# EasyEDA Pro project ProProject_IMUSensorNodes202312.epro, board 6_6_拼板20240123（不带编号） (continued)
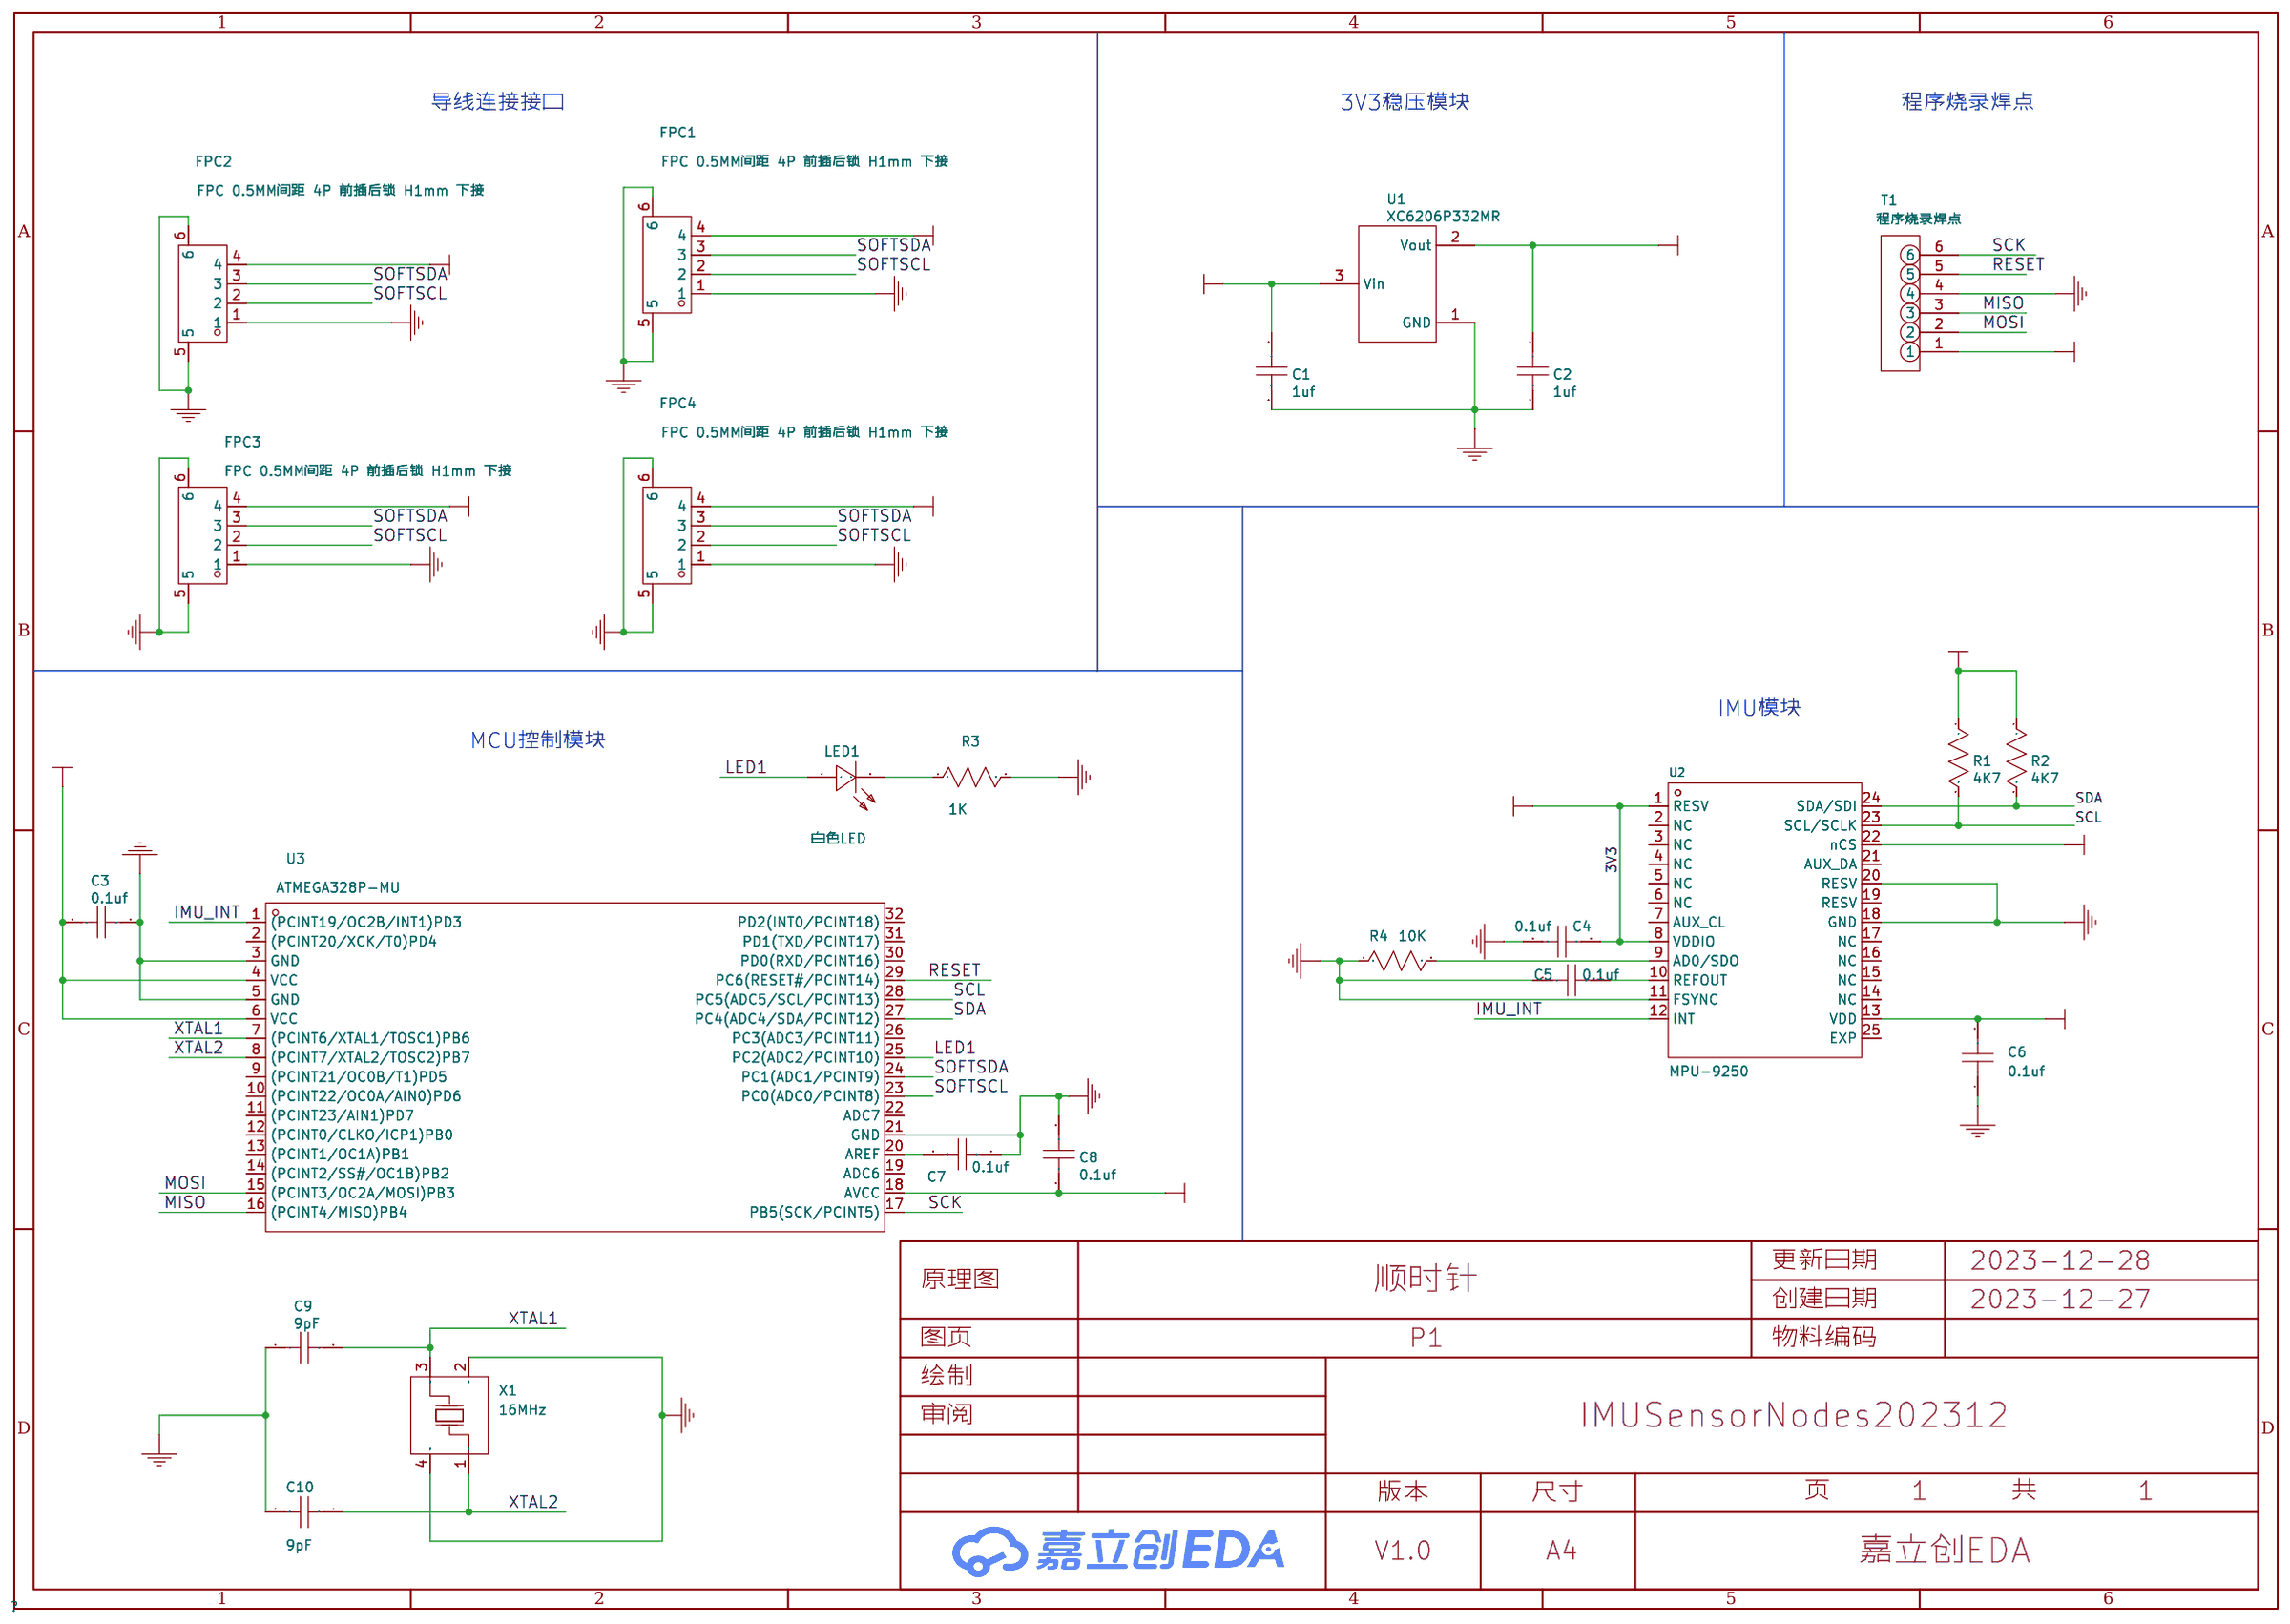
[diagram p0: schematic sheet]
## Routing (per net, layer and track width the routed paths; a pad name or vN(x,y) marks a point on that pad's centre or on a via; arc(x,y) is an arc through that point) (continued)
  Bottom Layer w0.2: U3#90.33 17.81,3.72 v1(17.81,2.38) U3#90.21 ; 17.32,21.72 17.32,22.02 18.32,23.02 U2#22.25 18.92,22.54 U2#22.11 20.54,22.54 v1(20.73,22.35) 21.27,22.88 C5#10.1 R4#9.1 ; U3#69.21 v1(45.12,70.96) 45.12,72.3 U3#69.33 ; R4#8.1 C5#9.1 7.68,22.76 7.43,22.51 6.07,22.51 U2#33.11 ; U3#86.21 v1(45.12,2.38) 45.12,3.72 U3#86.33 ; R4#7.1 C5#8.1 75.88,77.74 v1(75.34,77.21) 75.15,77.41 73.53,77.41 U2#36.25 72.93,77.88 71.93,76.88 U2#36.18 ; R4#19.1 C5#20.1 7.68,77.62 7.43,77.37 6.07,77.37 6.03,77.41 ; U2#2.18 44.62,22.02 45.62,23.02 U2#2.25 46.22,22.54 U2#2.11 47.84,22.54 v1(48.04,22.35) 48.57,22.88 C5#12.1 R4#11.1 ; U3#71.33 17.81,72.3 v1(17.81,70.96) U3#71.21 ; R4#26.1 C5#27.1 34.98,63.91 34.73,63.66 33.37,63.66 U2#31.11 ; R4.1 C5.1 75.88,22.88 v1(75.34,22.35) 75.15,22.54 U2#35.11 73.53,22.54 U2#35.25 72.93,23.02 71.93,22.02 U2#35.18 ; R4#29.1 C5#30.1 75.88,64.03 v1(75.34,63.5) 75.15,63.69 U2#32.11 73.53,63.69 U2#32.25 72.93,64.16 71.93,63.16 U2#32.18 ; R4#13.1 C5#14.1 7.68,9.04 7.43,8.79 6.07,8.79 U2#11.11 ; U3#61.21 v1(72.42,57.25) 72.42,58.58 U3#61.33 ; U3#84.33 17.81,44.86 v1(17.81,43.53) U3#84.21 ; 33.34,77.41 33.37,77.37 34.73,77.37 34.98,77.62 C5#23.1 R4#22.1 ; R4#34.1 C5#35.1 62.29,50.19 62.04,49.94 60.68,49.94 60.64,49.97 ; R4#4.1 C5#5.1 48.57,36.59 v1(48.04,36.06) 47.84,36.26 U2#3.11 46.22,36.26 U2#3.25 45.62,36.73 44.62,35.73 U2#3.18 ; U2#10.11 60.68,36.22 62.04,36.22 62.29,36.47 C5#6.1 R4#5.1 ; U3#64.33 45.12,44.86 v1(45.12,43.53) U3#64.21 ; U2#29.11 6.07,63.66 7.43,63.66 7.68,63.91 C5#25.1 R4#24.1 ; R4#20.1 C5#22.1 62.29,77.62 62.04,77.37 60.68,77.37 60.64,77.41 ; U3#78.21 v1(45.12,57.25) 45.12,58.58 U3#78.33 ; U3#87.33 72.42,31.15 v1(72.42,29.81) U3#87.21 ; 17.32,76.58 17.32,76.88 18.32,77.88 U2#7.25 18.92,77.41 20.54,77.41 v1(20.73,77.21) 21.27,77.74 C5#21.1 R4#21.1 ; U2#6.18 71.93,49.45 72.93,50.45 U2#6.25 73.53,49.97 75.15,49.97 v1(75.34,49.78) 75.88,50.31 C5#36.1 R4#35.1 ; U3#81.33 17.81,31.15 v1(17.81,29.81) U3#81.21 ; U3#83.21 v1(72.42,70.96) 72.42,72.3 U3#83.33 ; U2#8.11 33.37,36.22 34.73,36.22 34.98,36.47 C5#4.1 R4#3.1 ; U3#62.33 45.12,17.43 v1(45.12,16.1) U3#62.21 ; R4#16.1 C5#17.1 48.57,9.16 v1(48.04,8.63) 47.84,8.83 U2#19.11 46.22,8.83 U2#19.25 45.62,9.3 44.62,8.3 U2#19.18 ; U2#5.18 44.62,49.45 45.62,50.45 U2#5.25 46.22,49.97 47.84,49.97 v1(48.04,49.78) 48.57,50.31 C5#34.1 R4#33.1 ; R4#10.1 C5#11.1 34.98,22.76 34.73,22.51 33.37,22.51 U2#9.11 ; 33.34,49.97 33.37,49.94 34.73,49.94 34.98,50.19 C5#33.1 R4#32.1 ; U3#95.33 17.81,17.43 v1(17.81,16.1) U3#95.21 ; U2#4.11 6.07,36.22 7.43,36.22 7.68,36.47 C5#2.1 R4#36.1 ; U3#80.33 72.42,3.72 v1(72.42,2.38) U3#80.21 ; R4#15.1 C5#16.1 34.98,9.04 34.73,8.79 33.37,8.79 U2#25.11 ; R4#14.1 C5#15.1 21.27,9.16 v1(20.73,8.63) 20.54,8.83 U2#18.11 18.92,8.83 U2#18.25 18.32,9.3 17.32,8.3 17.32,8 ; R4#23.1 C5#24.1 48.57,77.74 v1(48.04,77.21) 47.84,77.41 46.22,77.41 U2#24.25 45.62,77.88 44.62,76.88 U2#24.18 ; U3#94.21 v1(72.42,16.1) 72.42,17.43 U3#94.33 ; U2#13.11 60.68,63.66 62.04,63.66 62.29,63.91 C5#29.1 R4#28.1 ; U3#67.21 v1(72.42,43.53) 72.42,44.86 U3#67.33 ; U2#23.11 60.68,8.79 62.04,8.79 62.29,9.04 C5#18.1 R4#17.1 ; R4#31.1 C5#32.1 21.27,50.31 v1(20.73,49.78) 20.54,49.97 18.92,49.97 U2#14.25 18.32,50.45 17.32,49.45 17.32,49.15 ; R4#27.1 C5#28.1 48.57,64.03 v1(48.04,63.5) 47.84,63.69 U2#34.11 46.22,63.69 U2#34.25 45.62,64.16 44.62,63.16 U2#34.18 ; 17.32,35.43 17.32,35.73 18.32,36.73 U2#28.25 18.92,36.26 U2#28.11 20.54,36.26 v1(20.73,36.06) 21.27,36.59 C5#3.1 R4#2.1 ; 6.03,49.97 6.07,49.94 7.43,49.94 7.68,50.19 C5#31.1 R4#30.1 ; R4#18.1 C5#19.1 75.88,9.16 v1(75.34,8.63) 75.15,8.83 U2#20.11 73.53,8.83 U2#20.25 72.93,9.3 71.93,8.3 U2#20.18 ; U3#88.21 v1(17.81,57.25) 17.81,58.58 U3#88.33 ; R4#12.1 C5#13.1 62.29,22.76 62.04,22.51 60.68,22.51 U2#17.11 ; U2#16.18 71.93,35.73 72.93,36.73 U2#16.25 73.53,36.26 U2#16.11 75.15,36.26 v1(75.34,36.06) 75.88,36.59 C5#7.1 R4#6.1 ; U3#79.21 v1(45.12,29.81) 45.12,31.15 U3#79.33 ; 17.32,62.86 17.32,63.16 18.32,64.16 U2#12.25 18.92,63.69 U2#12.11 20.54,63.69 v1(20.73,63.5) 21.27,64.03 C5#26.1 R4#25.1
  Bottom Layer w0.254: 36.88,38.13 37.12,38.13 37.27,37.98 v2(37.27,37.88) 37.27,36.98 37.14,36.86 ; v1(0.92,28.98) 0.54,29.37 0.54,29.87 0.92,30.25 3.21,30.25 U3#65.33 ; U3#79.5 45.62,31.65 U3#79.33 45.24,31.4 v1(44.73,31.91) 44.62,32.02 U3#79.3 ; v1(42.6,21.71) 42.71,21.71 42.93,21.49 42.93,20.98 ; U3#80.3 71.92,4.59 v1(72.04,4.47) 72.55,3.97 U3#80.33 72.92,4.22 U3#80.5 ; C10#24.2 50.98,78.13 v1(50.98,79) 50.7,79.28 C9#24.1 ; C7#35.1 72.42,41.97 U3#67.21 ; C1#10.2 48.52,19.23 49,18.75 v1(49.28,18.75) 48.52,17.98 C8#10.2 ; U3#69.5 45.62,72.8 U3#69.33 45.24,72.55 v1(44.73,73.05) 44.62,73.17 U3#69.3 ; C8#8.2 21.21,17.98 v1(21.98,18.75) 21.7,18.75 21.21,19.23 C1#8.2 ; U3#85.33 57.82,2.82 55.53,2.82 55.15,2.44 55.15,1.93 v1(55.53,1.55) ; C8.2 21.21,31.7 v1(21.98,32.46) 21.7,32.46 21.21,32.95 C1.2 ; C1#33.2 48.52,46.66 49,46.18 v1(49.28,46.18) 48.52,45.41 C8#33.2 ; U2#22.20 17.72,22.54 arc(17.79,22.55) 17.86,22.56 arc(18.14,22.72) 18.3,23 arc(18.31,23.07) U2#22.25 ; C8#12.2 75.82,17.98 v1(76.59,18.75) 76.31,18.75 75.82,19.23 C1#12.2 ; U3#78.3 44.62,59.45 v1(44.73,59.34) 45.24,58.83 U3#78.33 45.62,59.08 U3#78.5 ; v1(69.9,35.43) 70.01,35.43 70.24,35.21 70.24,34.7 ; U3#73.33 30.51,16.54 28.22,16.54 27.84,16.16 27.84,15.65 v1(28.22,15.27) ; C9#22.1 23.39,79.28 v1(23.67,79) 23.67,78.13 C10#22.2 ; C9#30.1 78,65.56 v1(78.28,65.28) 78.28,64.41 C10#30.2 ; C7#31.1 17.81,41.97 U3#84.21 ; C9#2.1 78,24.41 v1(78.28,24.13) 78.28,23.26 C10#2.2 ; U3#87.21 72.42,28.25 C7#5.1 ; U3#94.5 72.92,17.93 U3#94.33 72.55,17.68 v1(72.04,18.19) 71.92,18.31 U3#94.3 ; C7#25.1 17.81,55.68 U3#88.21 ; v1(42.6,35.43) 42.71,35.43 42.93,35.21 42.93,34.7 ; v1(52.35,60.35) C2#27.2 ; U3#62.21 45.12,14.54 C7#10.1 ; C9#28.1 50.7,65.56 v1(50.98,65.28) 50.98,64.41 C10#28.2 ; C1#3.2 48.52,32.95 49,32.46 v1(49.28,32.46) 48.52,31.7 C8#3.2 ; C7#29.1 72.42,55.68 U3#61.21 ; C8#16.2 48.52,4.27 v1(49.28,5.03) 49,5.03 48.52,5.52 C1#16.2 ; v1(28.22,42.7) 27.84,43.08 27.84,43.59 28.22,43.97 30.51,43.97 U3#75.33 ; 9.58,38.13 9.81,38.13 9.96,37.98 v2(9.96,37.88) 9.96,36.98 9.84,36.86 ; v1(56.42,49.81) 56.42,49.41 C3#34.2 ; v1(29.11,49.81) 29.11,49.41 C3#32.2 ; v1(69.9,21.71) 70.01,21.71 70.24,21.49 70.24,20.98 ; U2#3.20 45.02,36.26 arc(45.1,36.26) 45.17,36.28 arc(45.45,36.44) 45.61,36.71 arc(45.62,36.79) U2#3.25 ; v1(79.66,74.07) C2#6.2 ; C1#23.2 48.52,74.1 49,73.61 v1(49.28,73.61) 48.52,72.85 C8#23.2 ; C3#7.2 1.81,21.97 v1(1.81,22.38) ; v1(79.66,19.21) C2#12.2 ; v1(79.66,32.92) C2#5.2 ; v1(1.81,77.25) 1.81,76.84 C3#19.2 ; v1(0.92,15.27) 0.54,15.65 0.54,16.16 0.92,16.54 3.21,16.54 U3#72.33 ; U3#64.3 44.62,45.74 v1(44.73,45.62) 45.24,45.11 U3#64.33 45.62,45.36 U3#64.5 ; U3#86.21 45.12,0.82 C7#16.1 ; U3#79.21 45.12,28.25 C7#3.1 ; 9.58,24.41 9.81,24.41 9.96,24.26 v2(9.96,24.16) 9.96,23.27 9.84,23.14 ; 36.88,65.56 37.12,65.56 37.27,65.41 v2(37.27,65.31) 37.27,64.42 37.14,64.29 ; C10#32.2 23.67,50.7 v1(23.67,51.57) 23.39,51.84 C9#32.1 ; 37.14,23.14 37.27,23.27 v2(37.27,24.16) 37.27,24.26 37.12,24.41 36.88,24.41 ; 37.14,78.01 37.27,78.13 v2(37.27,79.02) 37.27,79.13 37.12,79.28 36.88,79.28 ; v1(25.05,60.35) C2#25.2 ; C1#21.2 21.21,74.1 21.7,73.61 v1(21.98,73.61) 21.21,72.85 C8#21.2 ; C7#27.1 45.12,55.68 U3#78.21 ; U3#83.3 71.92,73.17 v1(72.04,73.05) 72.55,72.55 U3#83.33 72.92,72.8 U3#83.5 ; C10#9.2 78.28,78.13 v1(78.28,79) 78,79.28 C9#9.1 ; C3#28.2 56.42,63.12 v1(56.42,63.53) ; v1(69.9,8) 70.01,8 70.24,7.78 70.24,7.27 ; C7#12.1 72.42,14.54 U3#94.21 ; v1(29.11,77.25) 29.11,76.84 C3#22.2 ; 64.45,50.58 64.57,50.7 v2(64.57,51.59) 64.57,51.69 64.42,51.84 64.19,51.84 ; C3#2.2 29.11,35.69 v1(29.11,36.1) ; C1#31.2 21.21,46.66 21.7,46.18 v1(21.98,46.18) 21.21,45.41 C8#31.2 ; 64.19,65.56 64.42,65.56 64.57,65.41 v2(64.57,65.31) 64.57,64.42 64.45,64.29 ; 9.58,79.28 9.81,79.28 9.96,79.13 v2(9.96,79.02) 9.96,78.13 9.84,78.01 ; v1(52.35,46.64) C2#33.2 ; C3#9.2 29.11,21.97 v1(29.11,22.38) ; C3#11.2 56.42,21.97 v1(56.42,22.38) ; 42.93,48.42 42.93,48.92 42.71,49.15 v1(42.6,49.15) ; v1(52.35,74.07) C2#23.2 ; C8#18.2 75.82,4.27 v1(76.59,5.03) 76.31,5.03 75.82,5.52 C1#18.2 ; U3#88.5 18.31,59.08 U3#88.33 17.94,58.83 v1(17.43,59.34) 17.31,59.45 U3#88.3 ; 64.45,78.01 64.57,78.13 v2(64.57,79.02) 64.57,79.13 64.42,79.28 64.19,79.28 ; C1#29.2 75.82,60.38 76.31,59.89 v1(76.59,59.89) 75.82,59.13 C8#29.2 ; C8#27.2 48.52,59.13 v1(49.28,59.89) 49,59.89 48.52,60.38 C1#27.2 ; v1(79.66,46.64) C2#35.2 ; U2#2.20 45.02,22.54 arc(45.1,22.55) 45.17,22.56 arc(45.45,22.72) 45.61,23 arc(45.62,23.07) U2#2.25 ; C9#26.1 23.39,65.56 v1(23.67,65.28) 23.67,64.41 C10#26.2 ; v1(1.81,49.81) 1.81,49.41 C3#30.2 ; 9.84,9.43 9.96,9.55 v2(9.96,10.44) 9.96,10.55 9.81,10.7 9.58,10.7 ; C3#15.2 29.11,8.26 v1(29.11,8.66) ; 64.19,38.13 64.42,38.13 64.57,37.98 v2(64.57,37.88) 64.57,36.98 64.45,36.86 ; U3#89.33 57.82,43.97 55.53,43.97 55.15,43.59 55.15,43.08 v1(55.53,42.7) ; U2#16.20 72.33,36.26 arc(72.4,36.26) 72.47,36.28 arc(72.75,36.44) 72.91,36.71 arc(72.92,36.79) U2#16.25 ; C1#6.2 75.82,74.1 76.31,73.61 v1(76.59,73.61) 75.82,72.85 C8#6.2 ; v1(0.92,1.55) 0.54,1.93 0.54,2.44 0.92,2.82 3.21,2.82 U3#91.33 ; U2#18.20 17.72,8.83 arc(17.79,8.83) 17.86,8.84 arc(18.14,9) 18.3,9.28 arc(18.31,9.35) U2#18.25 ; C7#21.1 17.81,69.4 U3#71.21 ; v1(42.6,62.86) 42.71,62.86 42.93,62.64 42.93,62.13 ; U3#71.5 18.31,72.8 U3#71.33 17.94,72.55 v1(17.43,73.05) 17.31,73.17 U3#71.3 ; C10#15.2 23.67,9.55 v1(23.67,10.42) 23.39,10.7 C9#15.1 ; U3#74.33 3.21,57.69 0.92,57.69 0.54,57.31 0.54,56.8 v1(0.92,56.42) ; U2#12.20 17.72,63.69 arc(17.79,63.7) 17.86,63.71 arc(18.14,63.87) 18.3,64.15 arc(18.31,64.22) U2#12.25 ; U3#61.3 71.92,59.45 v1(72.04,59.34) 72.55,58.83 U3#61.33 72.92,59.08 U3#61.5 ; v1(15.29,21.71) 15.4,21.71 15.63,21.49 15.63,20.98 ; C9#19.1 78,10.7 v1(78.28,10.42) 78.28,9.55 C10#19.2 ; U3#70.33 30.51,30.25 28.22,30.25 27.84,29.87 27.84,29.37 v1(28.22,28.98) ; C9#11.1 23.39,24.41 v1(23.67,24.13) 23.67,23.26 C10#11.2 ; U3#83.21 72.42,69.4 C7#6.1 ; U2#20.20 72.33,8.83 arc(72.4,8.83) 72.47,8.84 arc(72.75,9) 72.91,9.28 arc(72.92,9.35) U2#20.25 ; U3#62.5 45.62,17.93 U3#62.33 45.24,17.68 v1(44.73,18.19) 44.62,18.31 U3#62.3 ; 9.84,64.29 9.96,64.42 v2(9.96,65.31) 9.96,65.41 9.81,65.56 9.58,65.56 ; C1#5.2 75.82,32.95 76.31,32.46 v1(76.59,32.46) 75.82,31.7 C8#5.2 ; U3#63.33 57.82,57.69 55.53,57.69 55.15,57.31 55.15,56.8 v1(55.53,56.42) ; v1(25.05,74.07) C2#21.2 ; v1(42.6,8) 42.71,8 42.93,7.78 42.93,7.27 ; C9#6.1 50.7,38.13 v1(50.98,37.85) 50.98,36.98 C10#6.2 ; U2#32.20 72.33,63.69 arc(72.4,63.7) 72.47,63.71 arc(72.75,63.87) 72.91,64.15 arc(72.92,64.22) U2#32.25 ; U3#96.33 3.21,71.4 0.92,71.4 0.54,71.02 0.54,70.51 v1(0.92,70.13) ; U3#67.5 72.92,45.36 U3#67.33 72.55,45.11 v1(72.04,45.62) 71.92,45.74 U3#67.3 ; v1(25.05,46.64) C2#31.2 ; 9.84,50.58 9.96,50.7 v2(9.96,51.59) 9.96,51.69 9.81,51.84 9.58,51.84 ; U3#84.5 18.31,45.36 U3#84.33 17.94,45.11 v1(17.43,45.62) 17.31,45.74 U3#84.3 ; U3#81.3 17.31,32.02 v1(17.43,31.91) 17.94,31.4 U3#81.33 18.31,31.65 U3#81.5 ; 15.63,62.13 15.63,62.64 15.4,62.86 v1(15.29,62.86) ; U3#95.3 17.31,18.31 v1(17.43,18.19) 17.94,17.68 U3#95.33 18.31,17.93 U3#95.5 ; v1(15.29,76.58) 15.4,76.58 15.63,76.36 15.63,75.85 ; v1(55.53,15.27) 55.15,15.65 55.15,16.16 55.53,16.54 57.82,16.54 U3#93.33 ; v1(52.35,19.21) C2#10.2 ; C3#13.2 1.81,8.26 v1(1.81,8.66) ; v1(15.29,35.43) 15.4,35.43 15.63,35.21 15.63,34.7 ; C1#35.2 75.82,46.66 76.31,46.18 v1(76.59,46.18) 75.82,45.41 C8#35.2 ; v1(1.81,36.1) 1.81,35.69 C3#36.2 ; U3#87.5 72.92,31.65 U3#87.33 72.55,31.4 v1(72.04,31.91) 71.92,32.02 U3#87.3 ; v1(55.53,28.98) 55.15,29.37 55.15,29.87 55.53,30.25 57.82,30.25 U3#82.33 ; 64.19,10.7 64.42,10.7 64.57,10.55 v2(64.57,10.44) 64.57,9.55 64.45,9.43 ; v1(25.05,5.49) C2#14.2 ; v1(56.42,36.1) 56.42,35.69 C3#4.2 ; 70.24,62.13 70.24,62.64 70.01,62.86 v1(69.9,62.86) ; v1(0.92,42.7) 0.54,43.08 0.54,43.59 0.92,43.97 3.21,43.97 U3#68.33 ; U3#90.5 18.31,4.22 U3#90.33 17.94,3.97 v1(17.43,4.47) 17.31,4.59 U3#90.3 ; U3#86.3 44.62,4.59 v1(44.73,4.47) 45.24,3.97 U3#86.33 45.62,4.22 U3#86.5 ; 44.2,77.41 45.02,77.41 arc(45.1,77.41) 45.17,77.42 arc(45.45,77.58) 45.61,77.86 arc(45.62,77.93) U2#24.25 ; U3#80.21 72.42,0.82 C7#18.1 ; U3#95.21 17.81,14.54 C7#8.1 ; v1(25.05,19.21) C2#8.2 ; C3#20.2 56.42,76.84 v1(56.42,77.25) ; 37.14,9.43 37.27,9.55 v2(37.27,10.44) 37.27,10.55 37.12,10.7 36.88,10.7 ; C9#13.1 50.7,24.41 v1(50.98,24.13) 50.98,23.26 C10#13.2 ; 15.63,48.42 15.63,48.92 15.4,49.15 v1(15.29,49.15) ; U2#28.20 17.72,36.26 arc(17.79,36.26) 17.86,36.28 arc(18.14,36.44) 18.3,36.71 arc(18.31,36.79) U2#28.25 ; 42.93,75.85 42.93,76.36 42.71,76.58 v1(42.6,76.58) ; U3#76.33 30.51,57.69 28.22,57.69 27.84,57.31 27.84,56.8 v1(28.22,56.42) ; v1(28.22,70.13) 27.84,70.51 27.84,71.02 28.22,71.4 30.51,71.4 U3#77.33 ; v1(79.66,5.49) C2#18.2 ; C3#26.2 29.11,63.12 v1(29.11,63.53) ; C9#36.1 78,51.84 v1(78.28,51.57) 78.28,50.7 C10#36.2 ; 64.19,24.41 64.42,24.41 64.57,24.26 v2(64.57,24.16) 64.57,23.27 64.45,23.14 ; 15.63,7.27 15.63,7.78 15.4,8 v1(15.29,8) ; v1(28.22,1.55) 27.84,1.93 27.84,2.44 28.22,2.82 30.51,2.82 U3#92.33 ; C10#17.2 50.98,9.55 v1(50.98,10.42) 50.7,10.7 C9#17.1 ; U2#19.20 45.02,8.83 arc(45.1,8.83) 45.17,8.84 arc(45.45,9) 45.61,9.28 arc(45.62,9.35) U2#19.25 ; v1(56.42,8.66) 56.42,8.26 C3#17.2 ; U2#35.20 72.33,22.54 arc(72.4,22.55) 72.47,22.56 arc(72.75,22.72) 72.91,23 arc(72.92,23.07) U2#35.25 ; C7.1 17.81,28.25 U3#81.21 ; v1(52.35,5.49) C2#16.2 ; v1(79.66,60.35) C2#29.2 ; C9#34.1 50.7,51.84 v1(50.98,51.57) 50.98,50.7 C10#34.2 ; C8#14.2 21.21,4.27 v1(21.98,5.03) 21.7,5.03 21.21,5.52 C1#14.2 ; v1(69.9,49.15) 70.01,49.15 70.24,48.92 70.24,48.42 ; U2#34.20 45.02,63.69 arc(45.1,63.7) 45.17,63.71 arc(45.45,63.87) 45.61,64.15 arc(45.62,64.22) U2#34.25 ; 16.89,77.41 17.72,77.41 arc(17.79,77.41) 17.86,77.42 arc(18.14,77.58) 18.3,77.86 arc(18.31,77.93) U2#7.25 ; U3#66.33 57.82,71.4 55.53,71.4 55.15,71.02 55.15,70.51 v1(55.53,70.13) ; 71.5,77.41 72.33,77.41 arc(72.4,77.41) 72.47,77.42 arc(72.75,77.58) 72.91,77.86 arc(72.92,77.93) U2#36.25 ; C9#8.1 78,38.13 v1(78.28,37.85) 78.28,36.98 C10#8.2 ; v1(25.05,32.92) C2.2 ; v1(52.35,32.92) C2#3.2 ; U3#64.21 45.12,41.97 C7#33.1 ; U3#90.21 17.81,0.82 C7#14.1 ; C3#24.2 1.81,63.12 v1(1.81,63.53) ; U3#69.21 45.12,69.4 C7#23.1 ; C1#25.2 21.21,60.38 21.7,59.89 v1(21.98,59.89) 21.21,59.13 C8#25.2 ; 16.89,49.97 17.72,49.97 arc(17.79,49.98) 17.86,49.99 arc(18.14,50.15) 18.3,50.43 arc(18.31,50.5) U2#14.25 ; C9#4.1 23.39,38.13 v1(23.67,37.85) 23.67,36.98 C10#4.2 ; 36.88,51.84 37.12,51.84 37.27,51.69 v2(37.27,51.59) 37.27,50.7 37.14,50.58 ; v1(69.9,76.58) 70.01,76.58 70.24,76.36 70.24,75.85 ; 71.5,49.97 72.33,49.97 arc(72.4,49.98) 72.47,49.99 arc(72.75,50.15) 72.91,50.43 arc(72.92,50.5) U2#6.25 ; 44.2,49.97 45.02,49.97 arc(45.1,49.98) 45.17,49.99 arc(45.45,50.15) 45.61,50.43 arc(45.62,50.5) U2#5.25
  vias: v1(3.2,73.01) v1(3.21,71.78) v1(3.2,59.3) v1(3.21,58.07) v1(3.2,45.58) v1(3.21,44.35) v1(3.2,31.87) v1(3.21,30.64) v1(3.2,18.15) v1(3.21,16.92) v1(3.2,4.43) v1(3.21,3.2) v1(4.13,78.15) v1(4.13,77.5) v1(4.13,64.44) v1(4.13,63.79) v1(4.13,50.72) v1(4.13,50.07) v1(4.13,37) v1(4.13,36.36) v1(4.13,23.29) v1(4.13,22.64) v1(4.13,9.57) v1(4.13,8.93) v1(4.35,73.01) v1(4.33,71.78) v1(4.35,59.3) v1(4.33,58.06) v1(4.35,45.58) v1(4.33,44.35) v1(4.35,31.87) v1(4.33,30.63) v1(4.35,18.15) v1(4.33,16.91) v1(4.35,4.43) v1(4.33,3.2) v1(5.14,78.15) v1(5.14,64.44) v1(5.14,50.72) v1(5.14,37) v1(5.14,23.29) v1(5.14,9.57) v1(10.19,69.24) v1(10.19,55.53) v1(10.19,41.81) v1(10.19,28.1) v1(10.19,14.38) v1(10.19,0.66) v1(10.7,76.1) v1(10.7,62.39) v1(10.7,48.67) v1(10.7,34.95) v1(10.7,21.24) v1(10.7,7.52) v1(11.21,77.75) v1(11.21,64.04) v1(11.21,50.32) v1(11.21,36.61) v1(11.21,22.89) v1(11.21,9.17) v1(16.67,72.22) v1(16.67,58.5) v1(16.67,44.78) v1(16.67,31.07) v1(16.67,17.35) v1(16.67,3.64) v1(17.18,76.48) v1(17.18,62.77) v1(17.18,49.05) v1(17.18,35.33) v1(17.18,21.62) v1(17.18,7.9) v1(18.7,71.28) v1(18.7,57.56) v1(18.7,43.84) v1(18.7,30.13) v1(18.7,16.41) v1(18.7,2.7) v1(24.39,72.98) v1(24.39,59.26) v1(24.39,45.54) v1(24.39,31.83) v1(24.39,18.11) v1(24.39,4.4) v1(24.92,77.82) v1(24.92,64.1) v1(24.92,50.38) v1(24.92,36.67) v1(24.92,22.95) v1(24.92,9.24) v1(30.5,73.01) v1(30.51,71.78) v1(30.5,59.3) v1(30.51,58.07) v1(30.5,45.58) v1(30.51,44.35) v1(30.5,31.87) v1(30.51,30.64) v1(30.5,18.15) v1(30.51,16.92) v1(30.5,4.43) v1(30.51,3.2) v1(31.43,78.15) v1(31.43,77.5) v1(31.43,64.44) v1(31.43,63.79) v1(31.43,50.72) v1(31.43,50.07) v1(31.43,37) v1(31.43,36.36) v1(31.43,23.29) v1(31.43,22.64) v1(31.43,9.57) v1(31.43,8.93) v1(31.64,71.78) v1(31.64,58.06) v1(31.64,44.35) v1(31.64,30.63) v1(31.64,16.91) v1(31.64,3.2) v1(31.65,73.01) v1(31.65,59.3) v1(31.65,45.58) v1(31.65,31.87) v1(31.65,18.15) v1(31.65,4.43) v1(32.45,78.15) v1(32.45,64.44) v1(32.45,50.72) v1(32.45,37) v1(32.45,23.29) v1(32.45,9.57) v1(37.5,69.24) v1(37.5,55.53) v1(37.5,41.81) v1(37.5,28.1) v1(37.5,14.38) v1(37.5,0.66) v1(38,76.1) v1(38,62.39) v1(38,48.67) v1(38,34.95) v1(38,21.24) v1(38,7.52) v1(38.51,77.75) v1(38.51,64.04) v1(38.51,50.32) v1(38.51,36.61) v1(38.51,22.89) v1(38.51,9.17) v1(43.97,72.22) v1(43.97,58.5) v1(43.97,44.78) v1(43.97,31.07) v1(43.97,17.35) v1(43.97,3.64) v1(44.48,76.48) v1(44.48,62.77) v1(44.48,49.05) v1(44.48,35.33) v1(44.48,21.62) v1(44.48,7.9) v1(46,71.28) v1(46,57.56) v1(46,43.84) v1(46,30.13) v1(46,16.41) v1(46,2.7) v1(51.69,72.98) v1(51.69,59.26) v1(51.69,45.54) v1(51.69,31.83) v1(51.69,18.11) v1(51.69,4.4) v1(52.23,77.82) v1(52.23,64.1) v1(52.23,50.38) v1(52.23,36.67) v1(52.23,22.95) v1(52.23,9.24) v1(57.81,73.01) v1(57.82,71.78) v1(57.81,59.3) v1(57.82,58.07) v1(57.81,45.58) v1(57.82,44.35) v1(57.81,31.87) v1(57.82,30.64) v1(57.81,18.15) v1(57.82,16.92) v1(57.81,4.43) v1(57.82,3.2) v1(58.74,78.15) v1(58.74,77.5) v1(58.74,64.44) v1(58.74,63.79) v1(58.74,50.72) v1(58.74,50.07) v1(58.74,37) v1(58.74,36.36) v1(58.74,23.29) v1(58.74,22.64) v1(58.74,9.57) v1(58.74,8.93) v1(58.94,71.78) v1(58.94,58.06) v1(58.94,44.35) v1(58.94,30.63) v1(58.94,16.91) v1(58.94,3.2) v1(58.96,73.01) v1(58.96,59.3) v1(58.96,45.58) v1(58.96,31.87) v1(58.96,18.15) v1(58.96,4.43) v1(59.75,78.15) v1(59.75,64.44) v1(59.75,50.72) v1(59.75,37) v1(59.75,23.29) v1(59.75,9.57) v1(64.8,69.24) v1(64.8,55.53) v1(64.8,41.81) v1(64.8,28.1) v1(64.8,14.38) v1(64.8,0.66) v1(65.31,76.1) v1(65.31,62.39) v1(65.31,48.67) v1(65.31,34.95) v1(65.31,21.24) v1(65.31,7.52) v1(65.82,77.75) v1(65.82,64.04) v1(65.82,50.32) v1(65.82,36.61) v1(65.82,22.89) v1(65.82,9.17) v1(71.28,72.22) v1(71.28,58.5) v1(71.28,44.78) v1(71.28,31.07) v1(71.28,17.35) v1(71.28,3.64) v1(71.79,76.48) v1(71.79,62.77) v1(71.79,49.05) v1(71.79,35.33) v1(71.79,21.62) v1(71.79,7.9) v1(73.31,71.28) v1(73.31,57.56) v1(73.31,43.84) v1(73.31,30.13) v1(73.31,16.41) v1(73.31,2.7) v1(79,72.98) v1(79,59.26) v1(79,45.54) v1(79,31.83) v1(79,18.11) v1(79,4.4) v1(79.53,77.82) v1(79.53,64.1) v1(79.53,50.38) v1(79.53,36.67) v1(79.53,22.95) v1(79.53,9.24) v2(9.22,78.54) v2(9.22,64.82) v2(9.22,51.11) v2(9.22,37.39) v2(9.22,23.68) v2(9.22,9.96) v2(10.67,72.98) v2(10.67,59.26) v2(10.67,45.54) v2(10.67,31.83) v2(10.67,18.11) v2(10.67,4.4) v2(36.52,78.54) v2(36.52,64.82) v2(36.52,51.11) v2(36.52,37.39) v2(36.52,23.68) v2(36.52,9.96) v2(37.98,72.98) v2(37.98,59.26) v2(37.98,45.54) v2(37.98,31.83) v2(37.98,18.11) v2(37.98,4.4) v2(63.83,78.54) v2(63.83,64.82) v2(63.83,51.11) v2(63.83,37.39) v2(63.83,23.68) v2(63.83,9.96) v2(65.28,72.98) v2(65.28,59.26) v2(65.28,45.54) v2(65.28,31.83) v2(65.28,18.11) v2(65.28,4.4)
IMU_INT: length 484.8
  Top Layer w0.127: v1(75.04,38.17) 73.73,38.17 73.31,37.75 73.01,37.75 71.02,35.76 71.02,35.46 70.13,34.57 v1(70.13,33.81) ; v1(42.83,6.38) 42.83,7.14 43.72,8.03 43.72,8.33 45.7,10.32 46,10.32 46.43,10.74 v1(47.74,10.74) ; v2(56.29,32.54) 56.16,32.67 56.16,34.69 57.93,36.46 57.93,37.48 58.32,37.88 61.03,37.88 v1(61.33,38.17) ; v1(61.33,24.46) 61.03,24.16 58.32,24.16 57.93,23.77 57.93,22.74 56.16,20.98 56.16,18.95 v2(56.29,18.82) ; v1(42.83,20.09) 42.83,20.86 43.72,21.75 43.72,22.05 45.7,24.03 46,24.03 46.43,24.45 v1(47.74,24.45) ; v2(56.29,46.26) 56.16,46.38 56.16,48.41 57.93,50.18 57.93,51.2 58.32,51.59 61.03,51.59 v1(61.33,51.89) ; v2(56.29,73.69) 56.16,73.82 56.16,75.84 57.93,77.61 57.93,78.63 58.32,79.02 61.03,79.02 v1(61.33,79.32) ; v1(15.52,74.96) 15.52,75.72 16.41,76.61 16.41,76.91 18.4,78.9 18.7,78.9 19.12,79.32 v1(20.43,79.32) ; v2(56.29,59.97) 56.16,60.1 56.16,62.12 57.93,63.89 57.93,64.92 58.32,65.31 61.03,65.31 v1(61.33,65.6) ; v1(34.02,65.6) 33.72,65.31 31.02,65.31 30.63,64.92 30.63,63.89 28.86,62.12 28.86,60.1 v2(28.99,59.97) ; v1(15.52,47.53) 15.52,48.29 16.41,49.18 16.41,49.48 18.4,51.46 18.7,51.46 19.12,51.89 v1(20.43,51.89) ; v1(15.52,20.09) 15.52,20.86 16.41,21.75 16.41,22.05 18.4,24.03 18.7,24.03 19.12,24.45 v1(20.43,24.45) ; v1(6.72,79.32) 6.42,79.02 3.71,79.02 3.32,78.63 3.32,77.61 1.55,75.84 1.55,73.82 v2(1.68,73.69) ; v1(20.43,65.6) 19.12,65.6 18.7,65.18 18.4,65.18 16.41,63.2 16.41,62.89 15.52,62 v1(15.52,61.24) ; v1(61.33,10.74) 61.03,10.44 58.32,10.44 57.93,10.05 57.93,9.03 56.16,7.26 56.16,5.24 v2(56.29,5.11) ; v1(70.13,6.38) 70.13,7.14 71.02,8.03 71.02,8.33 73.01,10.32 73.31,10.32 73.73,10.74 v1(75.04,10.74) ; v1(70.13,74.96) 70.13,75.72 71.02,76.61 71.02,76.91 73.01,78.9 73.31,78.9 73.73,79.32 v1(75.04,79.32) ; v1(42.83,74.96) 42.83,75.72 43.72,76.61 43.72,76.91 45.7,78.9 46,78.9 46.43,79.32 v1(47.74,79.32) ; v2(28.99,32.54) 28.86,32.67 28.86,34.69 30.63,36.46 30.63,37.48 31.02,37.88 33.72,37.88 v1(34.02,38.17) ; v1(47.74,65.6) 46.43,65.6 46,65.18 45.7,65.18 43.72,63.2 43.72,62.89 42.83,62 v1(42.83,61.24) ; v2(1.68,59.97) 1.55,60.1 1.55,62.12 3.32,63.89 3.32,64.92 3.71,65.31 6.42,65.31 v1(6.72,65.6) ; v1(75.04,65.6) 73.73,65.6 73.31,65.18 73.01,65.18 71.02,63.2 71.02,62.89 70.13,62 v1(70.13,61.24) ; v2(28.99,18.82) 28.86,18.95 28.86,20.98 30.63,22.74 30.63,23.77 31.02,24.16 33.72,24.16 v1(34.02,24.46) ; v1(20.43,38.17) 19.12,38.17 18.7,37.75 18.4,37.75 16.41,35.76 16.41,35.46 15.52,34.57 v1(15.52,33.81) ; v1(70.13,47.53) 70.13,48.29 71.02,49.18 71.02,49.48 73.01,51.46 73.31,51.46 73.73,51.89 v1(75.04,51.89) ; v1(42.83,47.53) 42.83,48.29 43.72,49.18 43.72,49.48 45.7,51.46 46,51.46 46.43,51.89 v1(47.74,51.89) ; v1(34.02,79.32) 33.72,79.02 31.02,79.02 30.63,78.63 30.63,77.61 28.86,75.84 28.86,73.82 v2(28.99,73.69) ; v1(6.72,51.89) 6.42,51.59 3.71,51.59 3.32,51.2 3.32,50.18 1.55,48.41 1.55,46.38 v2(1.68,46.26) ; v2(28.99,5.11) 28.86,5.24 28.86,7.26 30.63,9.03 30.63,10.05 31.02,10.44 33.72,10.44 v1(34.02,10.74) ; v1(70.13,20.09) 70.13,20.86 71.02,21.75 71.02,22.05 73.01,24.03 73.31,24.03 73.73,24.45 v1(75.04,24.45) ; v1(47.74,38.17) 46.43,38.17 46,37.75 45.7,37.75 43.72,35.76 43.72,35.46 42.83,34.57 v1(42.83,33.81) ; v1(15.52,6.38) 15.52,7.14 16.41,8.03 16.41,8.33 18.4,10.32 18.7,10.32 19.12,10.74 v1(20.43,10.74) ; v1(6.72,38.17) 6.42,37.88 3.71,37.88 3.32,37.48 3.32,36.46 1.55,34.69 1.55,32.67 v2(1.68,32.54) ; v2(1.68,5.11) 1.55,5.24 1.55,7.26 3.32,9.03 3.32,10.05 3.71,10.44 6.42,10.44 v1(6.72,10.74) ; v1(34.02,51.89) 33.72,51.59 31.02,51.59 30.63,51.2 30.63,50.18 28.86,48.41 28.86,46.38 v2(28.99,46.26) ; v1(6.72,24.46) 6.42,24.16 3.71,24.16 3.32,23.77 3.32,22.74 1.55,20.98 1.55,18.95 v2(1.68,18.82)
  Bottom Layer w0.127: v1(6.72,10.74) 7.01,10.44 7.83,10.44 7.98,10.29 7.98,10.11 8.03,10.06 8.03,8.92 7.54,8.43 U2#11.12 ; U2#18.12 20.01,8.16 20.95,8.16 21.66,8.87 21.66,10.27 21.37,10.57 20.6,10.57 v1(20.43,10.74) ; v1(47.74,24.45) 47.91,24.29 48.67,24.29 48.97,23.99 48.97,22.59 48.26,21.88 47.31,21.88 U2#2.12 ; v1(6.72,79.32) 7.01,79.02 7.83,79.02 7.98,78.87 7.98,78.69 8.03,78.64 8.03,77.5 7.54,77.01 U2.12 ; U2#28.12 20.01,35.6 20.95,35.6 21.66,36.31 21.66,37.71 21.37,38 20.6,38 v1(20.43,38.17) ; v1(47.74,10.74) 47.91,10.57 48.67,10.57 48.97,10.27 48.97,8.87 48.26,8.16 47.31,8.16 U2#19.12 ; U2#24.12 47.31,76.75 48.26,76.75 48.97,77.45 48.97,78.85 48.67,79.15 47.91,79.15 v1(47.74,79.32) ; U2#32.12 74.62,63.03 75.56,63.03 76.27,63.74 76.27,65.14 75.98,65.43 75.21,65.43 v1(75.04,65.6) ; v1(75.04,79.32) 75.21,79.15 75.98,79.15 76.27,78.85 76.27,77.45 75.56,76.75 74.62,76.75 U2#36.12 ; v1(75.04,24.45) 75.21,24.29 75.98,24.29 76.27,23.99 76.27,22.59 75.56,21.88 74.62,21.88 U2#35.12 ; U2#3.12 47.31,35.6 48.26,35.6 48.97,36.31 48.97,37.71 48.67,38 47.91,38 v1(47.74,38.17) ; U2#14.12 20.01,49.31 20.95,49.31 21.66,50.02 21.66,51.42 21.37,51.72 20.6,51.72 v1(20.43,51.89) ; v1(34.02,24.46) 34.32,24.16 35.14,24.16 35.29,24.01 35.29,23.83 35.34,23.78 35.34,22.64 34.84,22.14 U2#9.12 ; v1(61.33,51.89) 61.62,51.59 62.44,51.59 62.59,51.44 62.59,51.26 62.64,51.21 62.64,50.07 62.15,49.58 U2#26.12 ; v1(34.02,51.89) 34.32,51.59 35.14,51.59 35.29,51.44 35.29,51.26 35.34,51.21 35.34,50.07 34.84,49.58 U2#21.12 ; U2#16.12 74.62,35.6 75.56,35.6 76.27,36.31 76.27,37.71 75.98,38 75.21,38 v1(75.04,38.17) ; U2#20.12 74.62,8.16 75.56,8.16 76.27,8.87 76.27,10.27 75.98,10.57 75.21,10.57 v1(75.04,10.74) ; U2#33.12 7.54,22.14 8.03,22.64 8.03,23.78 7.98,23.83 7.98,24.01 7.83,24.16 7.01,24.16 v1(6.72,24.46) ; v1(34.02,65.6) 34.32,65.31 35.14,65.31 35.29,65.16 35.29,64.98 35.34,64.93 35.34,63.78 34.84,63.29 U2#31.12 ; v1(75.04,51.89) 75.21,51.72 75.98,51.72 76.27,51.42 76.27,50.02 75.56,49.31 74.62,49.31 U2#6.12 ; U2#30.12 7.54,49.58 8.03,50.07 8.03,51.21 7.98,51.26 7.98,51.44 7.83,51.59 7.01,51.59 v1(6.72,51.89) ; v1(34.02,10.74) 34.32,10.44 35.14,10.44 35.29,10.29 35.29,10.11 35.34,10.06 35.34,8.92 34.84,8.43 U2#25.12 ; v1(61.33,24.46) 61.62,24.16 62.44,24.16 62.59,24.01 62.59,23.83 62.64,23.78 62.64,22.64 62.15,22.14 U2#17.12 ; v1(61.33,38.17) 61.62,37.88 62.44,37.88 62.59,37.72 62.59,37.55 62.64,37.49 62.64,36.35 62.15,35.86 U2#10.12 ; v1(61.33,65.6) 61.62,65.31 62.44,65.31 62.59,65.16 62.59,64.98 62.64,64.93 62.64,63.78 62.15,63.29 U2#13.12 ; v1(47.74,51.89) 47.91,51.72 48.67,51.72 48.97,51.42 48.97,50.02 48.26,49.31 47.31,49.31 U2#5.12 ; v1(47.74,65.6) 47.91,65.43 48.67,65.43 48.97,65.14 48.97,63.74 48.26,63.03 47.31,63.03 U2#34.12 ; U2#7.12 20.01,76.75 20.95,76.75 21.66,77.45 21.66,78.85 21.37,79.15 20.6,79.15 v1(20.43,79.32) ; v1(6.72,65.6) 7.01,65.31 7.83,65.31 7.98,65.16 7.98,64.98 8.03,64.93 8.03,63.78 7.54,63.29 U2#29.12 ; U2#8.12 34.84,35.86 35.34,36.35 35.34,37.49 35.29,37.55 35.29,37.72 35.14,37.88 34.32,37.88 v1(34.02,38.17) ; U2#12.12 20.01,63.03 20.95,63.03 21.66,63.74 21.66,65.14 21.37,65.43 20.6,65.43 v1(20.43,65.6) ; U2#15.12 62.15,77.01 62.64,77.5 62.64,78.64 62.59,78.69 62.59,78.87 62.44,79.02 61.62,79.02 v1(61.33,79.32) ; v1(20.43,24.45) 20.6,24.29 21.37,24.29 21.66,23.99 21.66,22.59 20.95,21.88 20.01,21.88 U2#22.12 ; v1(6.72,38.17) 7.01,37.88 7.83,37.88 7.98,37.72 7.98,37.55 8.03,37.49 8.03,36.35 7.54,35.86 U2#4.12 ; U2#23.12 62.15,8.43 62.64,8.92 62.64,10.06 62.59,10.11 62.59,10.29 62.44,10.44 61.62,10.44 v1(61.33,10.74) ; v1(34.02,79.32) 34.32,79.02 35.14,79.02 35.29,78.87 35.29,78.69 35.34,78.64 35.34,77.5 34.84,77.01 U2#27.12
